# EasyEDA Pro project 效果器12-18.eprj, schematic DengFOC V3.01
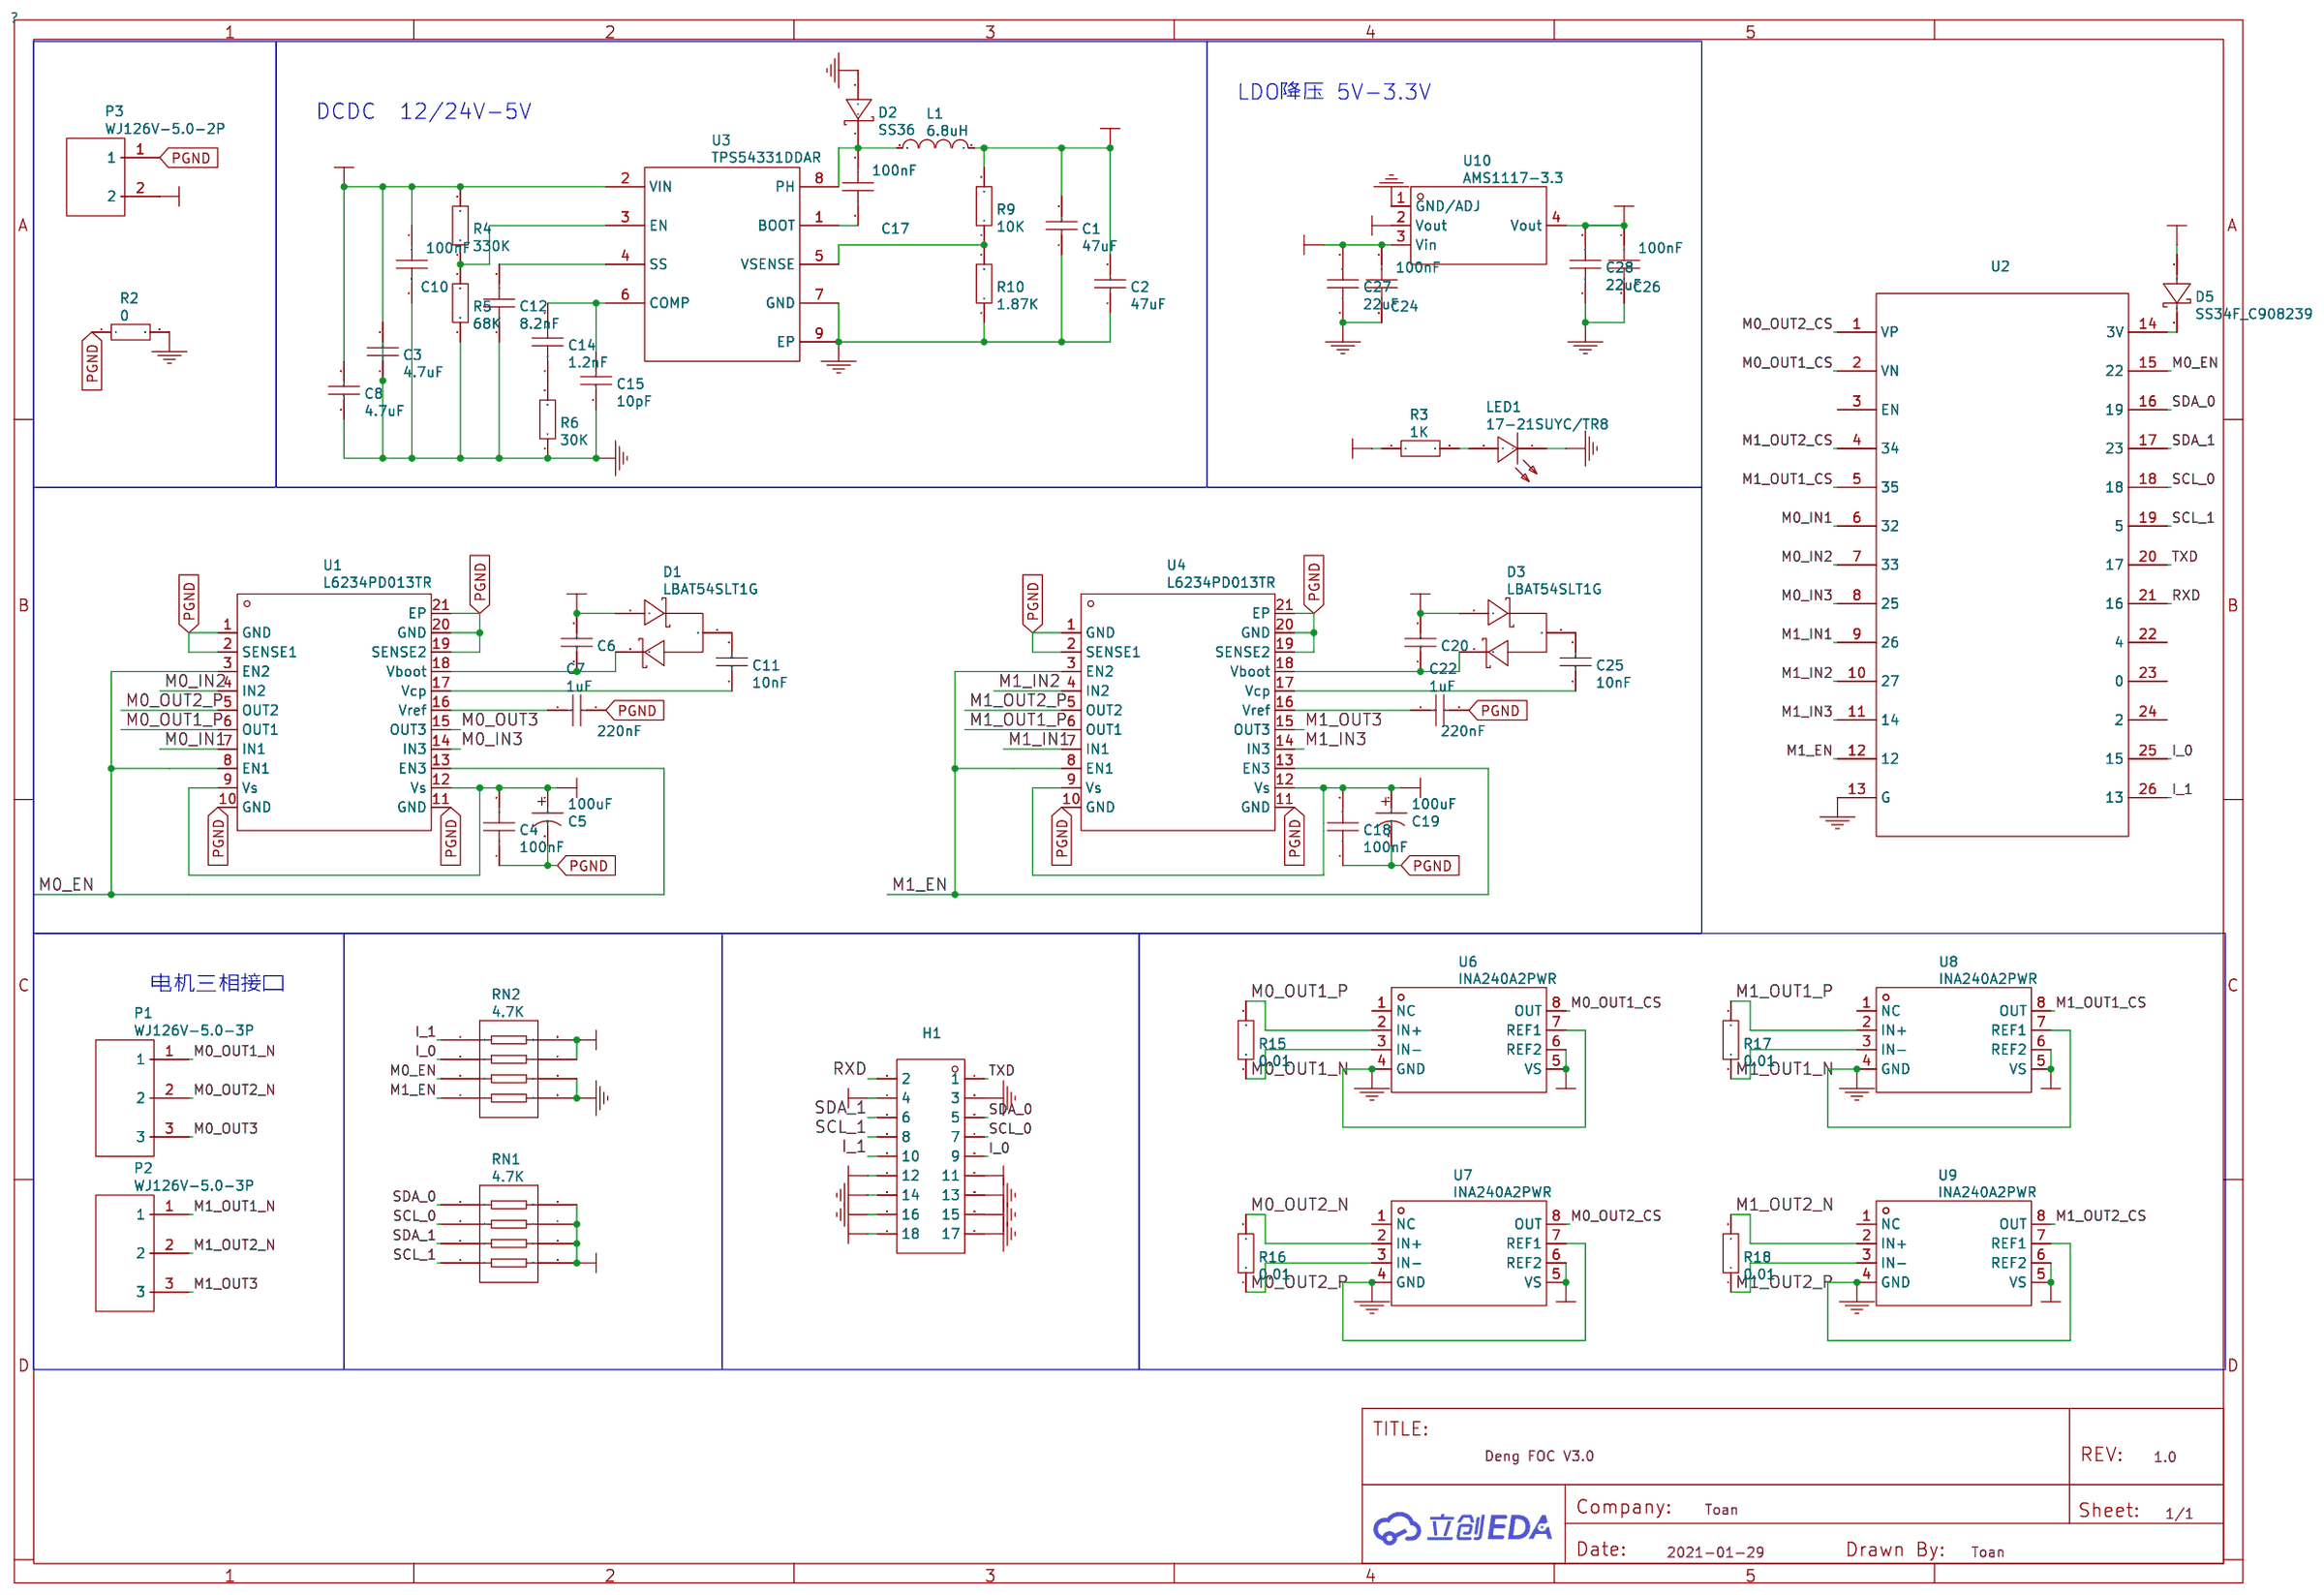
[diagram p6: schematic sheet]

## Parts
C1  47uF
C2  47uF
C3  4.7uF
C4  100nF
C5  100uF
C6  220nF
C7  1uF
C8  4.7uF
C10  100nF
C11  10nF
C12  8.2nF
C14  1.2nF
C15  10pF
C17  100nF
C18  100nF
C19  100uF
C20  220nF
C22  1uF
C24  100nF
C25  10nF
C26  100nF
C27  22uF
C28  22uF
D1  LBAT54SLT1G
D2  SS36
D3  LBAT54SLT1G
D5  SS34F_C908239
H1  Header-Female-2.54_2x9
L1  6.8uH
LED1  17-21SUYC/TR8
P1  WJ126V-5.0-3P
P2  WJ126V-5.0-3P
P3  WJ126V-5.0-2P
R2  0
R3  1K
R4  330K
R5  68K
R6  30K
R9  10K
R10  1.87K
R15  0.01
R16  0.01
R17  0.01
R18  0.01
RN1  4.7K
RN2  4.7K
U1  L6234PD013TR
U2  micropython esp32
U3  TPS54331DDAR
U4  L6234PD013TR
U6  INA240A2PWR
U7  INA240A2PWR
U8  INA240A2PWR
U9  INA240A2PWR
U10  AMS1117-3.3

## Library data of the parts
C1 C2 = GRM188R60J476ME15D: Supplier: LCSC; Manufacturer: MuRata; Supplier Part: C140782; JLCPCB Part Class: Extended Part
C3 C8 = CL21A475KBQNNNE: Supplier: LCSC; Manufacturer: SAMSUNG; Supplier Part: C98192; JLCPCB Part Class: Extended Part
C4 C18 = C0805X104K101T: Supplier: LCSC; Supplier Part: C485772; Manufacturer: HEC(Holy Stone Enterprise); JLCPCB Part Class: Extended Part
C5 C19 = RVE1V101M0607: Supplier: LCSC; Manufacturer: ROQANG; Supplier Part: C99837
C6 C20 = CL21B224KBFNNNE: Supplier: LCSC; Manufacturer: SAMSUNG; Supplier Part: C5378; JLCPCB Part Class: Basic
C7 C22 = CL21B105KBFNNNE: Supplier: LCSC; Manufacturer: SAMSUNG; Supplier Part: C28323; JLCPCB Part Class: Basic
C10 C17 C24 C26 = CC0603KRX7R9BB104: Supplier: LCSC; Manufacturer: YAGEO; Supplier Part: C14663; JLCPCB Part Class: Basic; JLCPCB SMD: Yes
C11 C25 = CL21A106KAYNNNE: Supplier: LCSC; Manufacturer: SAMSUNG; Supplier Part: C15850; JLCPCB Part Class: Basic
C12 = CL10B822KB8NNNC: Supplier: LCSC; Manufacturer: SAMSUNG; Supplier Part: C27920; Paste Type: base
C14 = FN18X122K500PSG: Supplier: LCSC; Supplier Part: C565591; Manufacturer: PSA(Prosperity Dielectrics)
C15 = CC0603JRNPO9BN100: Supplier: LCSC; Manufacturer: YAGEO; Supplier Part: C106245; JLCPCB Part Class: Extended Part
C27 C28 = CL10A226MQ8NRNC: Supplier: LCSC; Manufacturer: SAMSUNG; Supplier Part: C59461; Paste Type: base
D1 D3 = LBAT54SLT1G: Supplier: LCSC; Manufacturer: LRC; image: //image.lceda.cn/szlcsc/C12765.jpg; Supplier Part: C12765; JLCPCB Part Class: Extend; JLCPCB SMD: Yes
D2 = SS36: Supplier: LCSC; Manufacturer: MDD; image: //image.lceda.cn/szlcsc/C16015.jpg; Supplier Part: C16015; Paste Type: expand
D5 = SS34F: Supplier: LCSC; Supplier Part: C908239; Manufacturer: FUXINSEMI
H1 = Header-Female-2.54_2x9: Supplier: LCSC; Manufacturer: BOOMELE; Supplier Part: C71956; JLCPCB Part Class: Extended Part
L1 = SWPA5040S6R8M: Supplier: LCSC; Manufacturer: Sunlord; Supplier Part: C36411; JLCPCB Part Class: Extended Part
LED1 = 17-21SUYC/TR8: Supplier: LCSC; Manufacturer: KENTO; image: //image.lceda.cn/szlcsc/C2296.jpg; Supplier Part: C2296; JLCPCB Part Class: Basic
P1 P2 = WJ126V-5.0-3P: Supplier: LCSC; Manufacturer: ReliaPro; Supplier Part: C8401; JLCPCB Part Class: Extended Part
P3 = WJ126V-5.0-2P: Supplier: LCSC; Manufacturer: ReliaPro; Supplier Part: C8404; JLCPCB Part Class: Extended Part
R2 = RM10FTN0: Supplier: LCSC; Supplier Part: C254574; Manufacturer: TA-I Tech
R3 = 0805W8F1001T5E: Supplier: LCSC; Manufacturer: UniOhm; Supplier Part: C17513; JLCPCB Part Class: Basic
R4 = 0603WAF3303T5E: Supplier: LCSC; Manufacturer: UniOhm; Supplier Part: C23137; Paste Type: base
R5 = 0603WAF6802T5E: Supplier: LCSC; Manufacturer: UniOhm; Supplier Part: C23231; Paste Type: base
R6 = 0603WAF3002T5E: Supplier: LCSC; Manufacturer: UniOhm; Supplier Part: C22984; JLCPCB Part Class: Basic Part
R9 = 0603WAF1002T5E: Supplier: LCSC; Manufacturer: UniOhm; Supplier Part: C25804; JLCPCB Part Class: Basic Part
R10 = 0603WAF1871T5E: Supplier: LCSC; Manufacturer: UniOhm; Supplier Part: C22850; JLCPCB Part Class: Extended Part
R15-R18 = RTT06R010FTP: Supplier: LCSC; Manufacturer: RALEC; Supplier Part: C104920
RN1 RN2 = 4D03WGF4701T5E: Supplier: LCSC; Manufacturer: UniOhm; Supplier Part: C66697; Paste Type: Extended Part; JLCPCB Part Class: Extended Part
U1 U4 = L6234PD013TR: Supplier: LCSC; Manufacturer: STMicroelectronics; Supplier Part: C77581
U2 = micropython esp32
U3 = TPS54331DDAR: Supplier: LCSC; Manufacturer: TI; Supplier Part: C90761; JLCPCB Part Class: Extended Part
U6-U9 = INA240A2PWR: Supplier: LCSC; Manufacturer: TI; Supplier Part: C129949; Paste Type: expand
U10 = AMS1117-3.3: Supplier: LCSC; Manufacturer: AMS; image: //image.lceda.cn/szlcsc/C6186.jpg; Supplier Part: C6186; JLCPCB Part Class: Basic; JLCPCB SMD: Yes

## Nets
GND: C1.1 C2.1 C3.1 C8.1 C10.2 C12.1 C15.1 C24.2 C26.2 C27.1 C28.1 D2.2(A) H1.3 H1.13 H1.14 H1.15 H1.16 H1.17 LED1.1(-) R2.2 R5.1 R6.1 R10.1 RN2.5 RN2.6 U2.13(G) U3.7(GND) U3.9(EP) U6.4(GND) U6.7(REF1) U7.4(GND) U7.7(REF1) U8.4(GND) U8.7(REF1) U9.4(GND) U9.7(REF1) U10.1(GND/ADJ)
PGND: C4.1 C5.2 C7.2 C18.1 C19.2 C22.2 P3.1 R2.1 U1.1(GND) U1.2(SENSE1) U1.10(GND) U1.11(GND) U1.19(SENSE2) U1.20(GND) U1.21(EP) U4.1(GND) U4.2(SENSE1) U4.10(GND) U4.11(GND) U4.19(SENSE2) U4.20(GND) U4.21(EP)
VCC-3.3V: C26.1 C28.2 D5.1(A) H1.4 H1.11 H1.12 R3.1 RN1.5 RN1.6 RN1.7 RN1.8 RN2.7 RN2.8 U6.5(VS) U6.6(REF2) U7.5(VS) U7.6(REF2) U8.5(VS) U8.6(REF2) U9.5(VS) U9.6(REF2) U10.2(Vout) U10.4(Vout)
VCC-5V: C1.2 C2.2 C24.1 C27.2 H1.18 L1.2 R9.2 U10.3(Vin)
VIN: C3.2 C4.2 C5.1 C6.1 C8.2 C10.1 C18.2 C19.1 C20.1 D1.1(A) D3.1(A) P3.2 R4.2 U1.9(Vs) U1.12(Vs) U3.2(VIN) U4.9(Vs) U4.12(Vs)
I_0: H1.9 RN2.2 U2.25(15)
I_1: H1.10 RN2.1 U2.26(13)
M0_EN: RN2.3 U1.3(EN2) U1.8(EN1) U1.13(EN3) U2.15(22)
M0_IN1: U1.7(IN1) U2.6(32)
M0_IN2: U1.4(IN2) U2.7(33)
M0_IN3: U1.14(IN3) U2.8(25)
M0_OUT1_CS: U2.2(VN) U6.8(OUT)
M0_OUT1_N: P1.1 R15.1 U6.3(IN-)
M0_OUT1_P: R15.2 U1.6(OUT1) U6.2(IN+)
M0_OUT2_CS: U2.1(VP) U7.8(OUT)
M0_OUT2_N: P1.2 R16.2 U7.2(IN+)
M0_OUT2_P: R16.1 U1.5(OUT2) U7.3(IN-)
M0_OUT3: P1.3 U1.15(OUT3)
M1_EN: RN2.4 U2.12 U4.3(EN2) U4.8(EN1) U4.13(EN3)
M1_IN1: U2.9(26) U4.7(IN1)
M1_IN2: U2.10(27) U4.4(IN2)
M1_IN3: U2.11(14) U4.14(IN3)
M1_OUT1_CS: U2.5(35) U8.8(OUT)
M1_OUT1_N: P2.1 R17.1 U8.3(IN-)
M1_OUT1_P: R17.2 U4.6(OUT1) U8.2(IN+)
M1_OUT2_CS: U2.4(34) U9.8(OUT)
M1_OUT2_N: P2.2 R18.2 U9.2(IN+)
M1_OUT2_P: R18.1 U4.5(OUT2) U9.3(IN-)
M1_OUT3: P2.3 U4.15(OUT3)
RXD: H1.2 U2.21(16)
SCL_0: H1.7 RN1.2 U2.18
SCL_1: H1.8 RN1.4 U2.19(5)
SDA_0: H1.5 RN1.1 U2.16(19)
SDA_1: H1.6 RN1.3 U2.17(23)
TXD: H1.1 U2.20(17)
Net-(C6-2): C6.2 D1.2(K) U1.18(Vboot)
Net-(C7-1): C7.1 U1.16(Vref)
Net-(C11-1): C11.1 U1.17(Vcp)
Net-(C11-2): C11.2 D1.3(AK)
Net-(C12-2): C12.2 U3.4(SS)
Net-(C14-1): C14.1 R6.2
Net-(C14-2): C14.2 C15.2 U3.6(COMP)
Net-(C17-1): C17.1 D2.1(K) L1.1 U3.8(PH)
Net-(C17-2): C17.2 U3.1(BOOT)
Net-(C20-2): C20.2 D3.2(K) U4.18(Vboot)
Net-(C22-1): C22.1 U4.16(Vref)
Net-(C25-1): C25.1 U4.17(Vcp)
Net-(C25-2): C25.2 D3.3(AK)
Net-(D5-2): D5.2(K) U2.14(3V)
Net-(LED1-2): LED1.2(+) R3.2
Net-(R4-1): R4.1 R5.2 U3.3(EN)
Net-(R9-1): R9.1 R10.2 U3.5(VSENSE)

Not connected (* = marked no-connect by the designer): U2 3(EN) 22(4) 23(0) 24(2); U6 1(NC); U7 1(NC); U8 1(NC); U9 1(NC)

## Notes on the sheet
- DCDC  12/24V-5V
- LDO降压 5V-3.3V
- 电机三相接口
